# EasyEDA Pro project ProPrj_Starcat_FOC双路矢量控制器_2024-11-11.epro, board 双路大功率矢量控制器_2
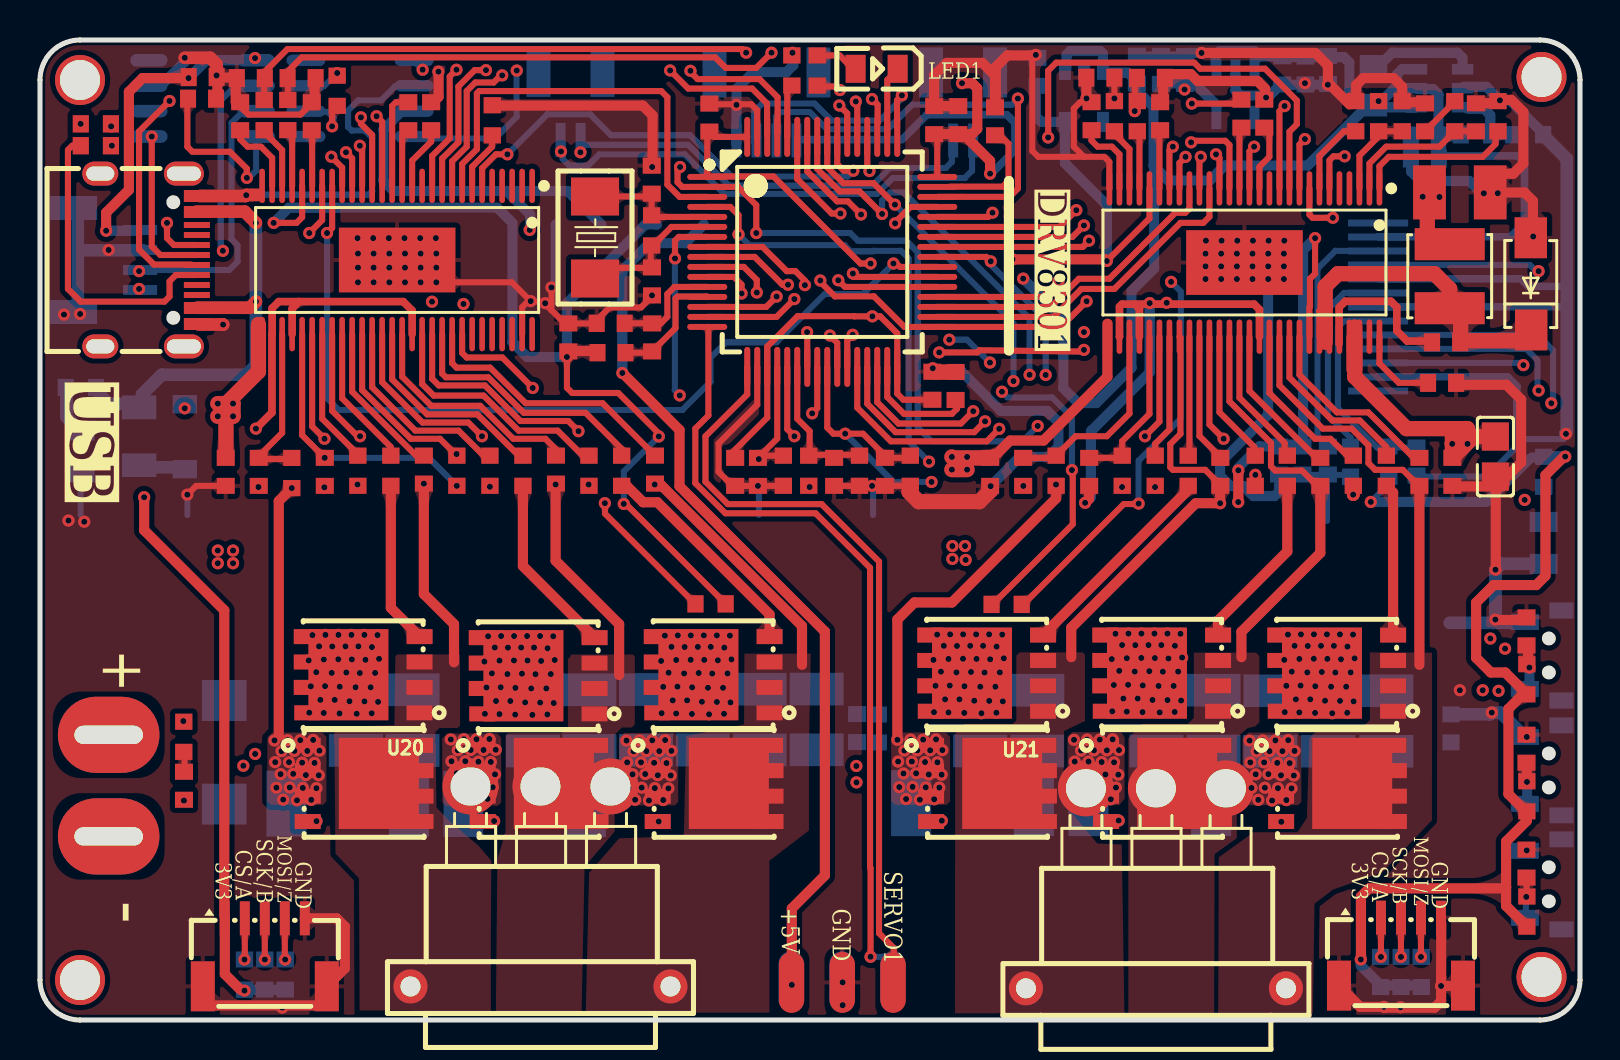
[diagram p7: board, top side]
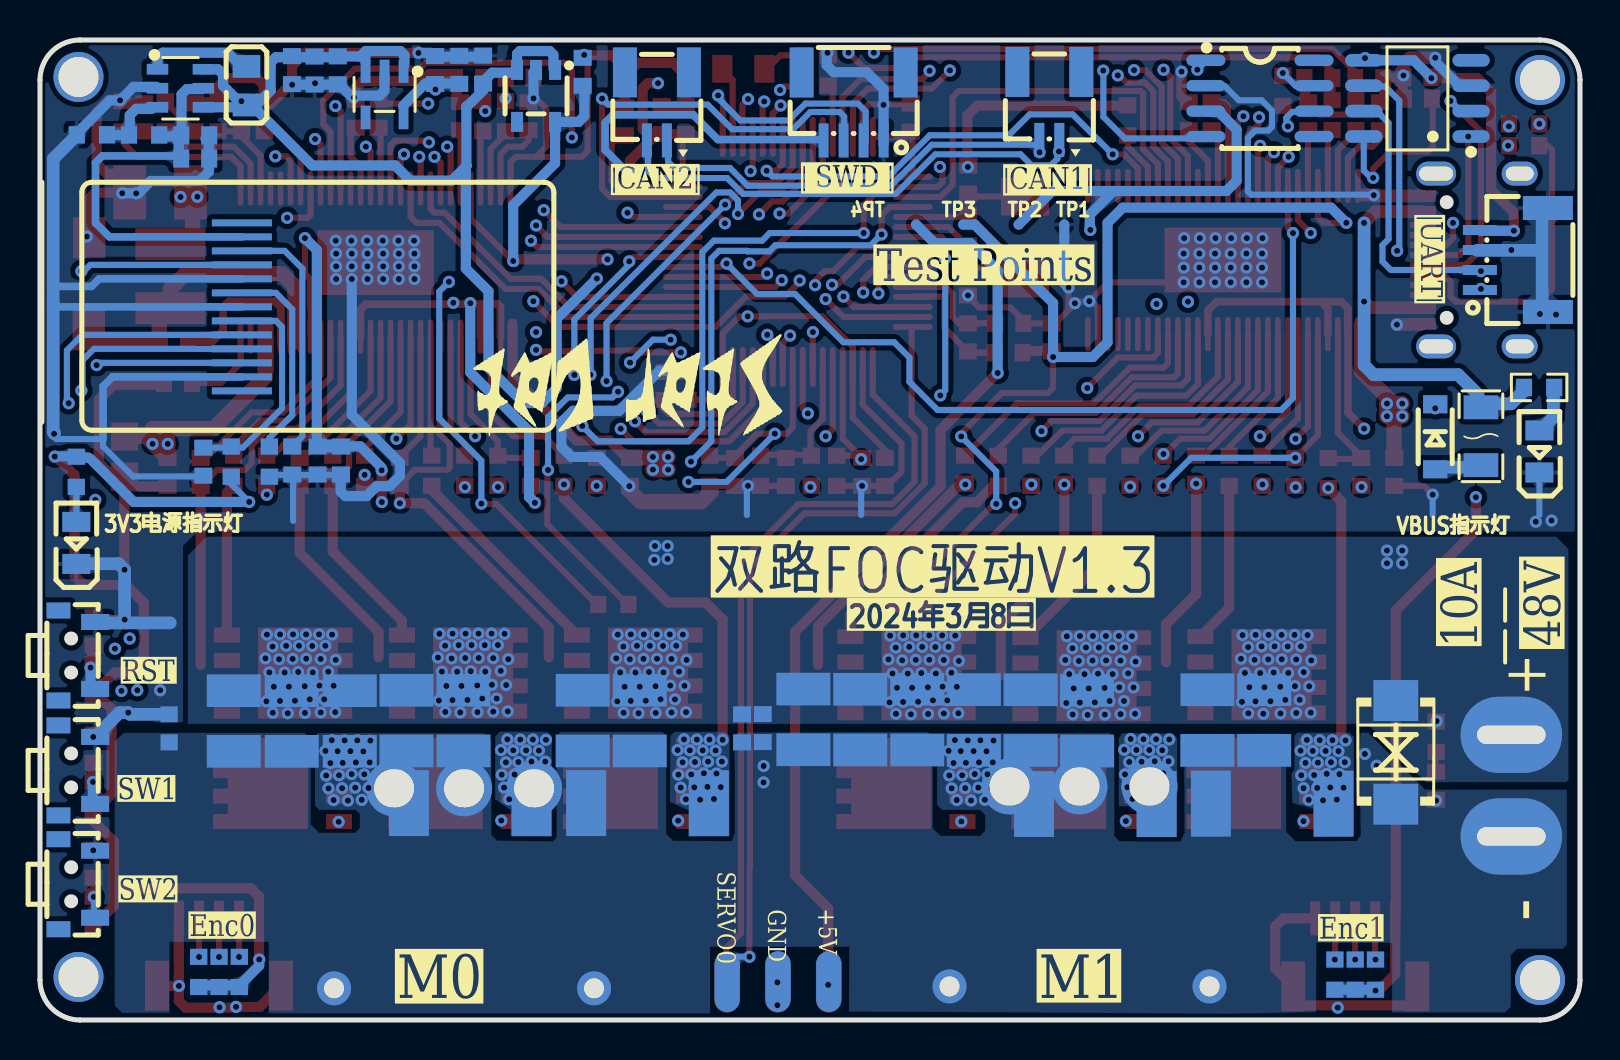
[diagram p8: board, bottom side, seen from below]

Outline 77 x 49 mm; copper layers: Top Layer, Inner1, Inner2, Bottom Layer. Coordinates in mm from the lower left corner of the outline.
Outline path: 0,47 0,2 arc(0.59,0.59) 2,0 75,0 arc(76.41,0.59) 77,2 77,47 arc(76.41,48.41) 75,49 2,49 arc(0.59,48.41) 0,47
Stack: Top Layer 0.035mm 外层铜厚1oz / Dielectric1 0.2104mm 7628 RC49% 8.6mil / Inner1 0.0152mm 内层铜厚 / Dielectric2 1.065mm 1.1mm H/HOZ 含铜 / Inner2 0.0152mm 内层铜厚 / Dielectric3 0.2104mm 7628 RC49% 8.6mil / Bottom Layer 0.035mm 外层铜厚1oz

## Design rules (mm)
template: JLCPCB Capability(Two Layers Board)
spacing copperThickness1oz (default): track to track 0.102, other pairs 0.152 to 0.3
spacing copperThickness2oz: track to track 0.203, other pairs 0.152 to 0.3
track width copperThickness1oz (default): min 0.127, default 0.254, max 2.54
track width copperThickness2oz: min 0.203, default 0.254, max 2.54
differential pair differentialPair (default): width min 0.127, default 0.254, max 2.54; gap min 0.152, default 0.152
via viaSize (default): diameter min 0.5, default 0.61, max 10; hole min 0.3, default 0.305, max 6.3

## Placement (name value [footprint] x y rotation side)
C1  100nF  [C0603]  62.11 47.48 270 bottom
C2  10uF  [C0603]  63.27 47.47 90 bottom
C3  100nF  [C0603]  26.42 34.13 90 top
C4  1uF  [C0603]  54.84 47.52 270 bottom
C5  100nF  [C0603]  30.61 34.13 90 top
C6  10uF  [C0603]  57.25 47.5 270 bottom
C7  100nF  [C0603]  56.04 47.51 90 bottom
C8  1uF  [C0603]  49.87 47.41 270 bottom
C9  10uF  [C0603]  74.32 19.43 270 top
C10  100nF  [C0603]  44.62 31.71 90 top
C11  100nF  [C0603]  45.91 44.99 90 top
C12  100nF  [C0603]  34.76 27.41 270 top
C13  100nF  [C0603]  33.47 45.12 90 top
C14  10uF  [C0603]  44.71 44.99 270 top
C15  2.2uF  [C0603]  45.78 31.7 270 top
C16  22pF  [C0603]  30.59 42.02 90 top
C17  2.2uF  [C0603]  47.75 44.94 270 top
C18  22pF  [C0603]  30.6 36.93 270 top
C19  100nF  [C0603]  8.1 46.07 180 top
C20  10uF  [C0603]  74.32 13.56 270 top
C21  100nF  [C0603]  8.13 47.14 0 top
C23  10uF  [C0603]  74.32 7.82 270 top
C24  1uF  [C0603]  64.4 47.49 90 bottom
C25  10uF  [C0603]  69.24 43.07 0 bottom
C26  10uF  [C0603]  69.24 44.23 0 bottom
C27  100nF  [C0603]  63.12 27.97 270 bottom
C28  10uF  [C0603]  64.39 27.97 270 bottom
C29  10uF  [C0603]  61.95 27.97 90 bottom
C30  10uF  [C0603]  68.83 27.92 90 bottom
C34  100uF  [C1210]  33.14 15.02 90 bottom
C35  100uF  [C1210]  30.31 15 90 bottom
C36  100uF  [C1210]  55.83 14.97 90 bottom
C37  100uF  [C1210]  47.01 14.97 90 bottom
C38  100uF  [C1210]  15.79 15 90 bottom
C39  100uF  [C1210]  24.65 14.97 90 bottom
C41  100nF  [C0603]  40.86 14.59 270 bottom
C43  10nF  [C0603]  7.2 11.71 90 top
C45  10uF  [C0603]  42.25 27.41 90 top
C46  10uF  [C0603]  35.9 27.41 90 top
C50  100uF  [C1210]  35.99 15.02 90 bottom
C51  100uF  [C1210]  38.83 15.03 90 bottom
C52  100uF  [C1210]  58.68 14.97 90 bottom
C53  100uF  [C1210]  49.86 14.97 90 bottom
C54  100uF  [C1210]  27.47 14.99 90 bottom
C55  100uF  [C1210]  18.63 15 90 bottom
C57  100nF  [C0603]  41.9 14.58 270 bottom
C59  82pF  [C0603]  71.79 45.13 270 top
C60  270pF  [C0603]  69.25 45.13 270 top
C61  15nF  [C0603]  70.1 31.86 0 top
C62  100nF  [C0603]  70.62 27.41 270 top
C63  10uF  [C0805]  72.77 28.17 90 top
C64  100nF  [C0603]  70.3 33.88 180 top
C65  100uF  [C1210]  70.99 41.38 180 top
C66  100nF  [C0603]  68.97 27.41 270 top
C67  100nF  [C0603]  30.75 27.52 270 top
C68  10uF  [C0603]  61.21 45.32 270 top
C69  100nF  [C0603]  64.02 27.41 270 top
C70  47nF  [C0603]  60.07 45.32 90 top
C71  10uF  [C0603]  19.56 45.19 270 top
C72  100nF  [C0603]  25.8 27.52 270 top
C73  47nF  [C0603]  18.41 45.19 270 top
C74  100nF  [C0603]  59.01 27.41 270 top
C75  100nF  [C0603]  19.19 27.52 270 top
C76  10uF  [C0603]  56.01 45.19 90 top
C77  10uF  [C0603]  13.59 45.19 90 top
C78  2.2nF  [C0603]  52.46 27.41 90 top
C79  2.2nF  [C0603]  14.24 27.41 90 top
C80  2.2nF  [C0603]  55.54 47.11 180 top
C81  2.2nF  [C0603]  13.08 47.09 180 top
C82  10uF  [C0603]  52.58 45.19 270 top
C83  10uF  [C0603]  10.01 45.19 270 top
C84  2.2nF  [C0603]  53.02 47.11 0 top
C85  100nF  [C0603]  47.51 27.41 270 top
C86  2.2nF  [C0603]  49.16 27.41 90 top
C87  2.2nF  [C0603]  10.54 47.09 0 top
C88  100nF  [C0603]  9.29 27.41 270 top
C89  2.2nF  [C0603]  10.94 27.41 90 top
C94  100uF  [C1210]  67.31 14.95 90 bottom
C95  100uF  [C1210]  64.41 14.95 90 bottom
C97  100uF  [C1210]  61.51 14.95 90 bottom
C98  10uF  [C0603]  39.71 27.41 90 top
CN1  WAFER-SH1.0-4PWB  [CONN-SMD_4P-P1.00_WAFER-SH1.0-4PWB]  36.32 45.68 0 bottom
CN2  WAFER-SH1.0-4PWB  [CONN-SMD_4P-P1.00_WAFER-SH1.0-4PWB]  3.31 38 90 bottom
D1  1N5819W  [SOD-123_L2.7-W1.6-LS3.7-R-RD]  7.24 29.16 270 bottom
D2  SMBJ60CA  [SMB_L4.6-W3.6-LS5.3-BI]  9.21 13.38 90 bottom
D3  SS56  [SMA_L4.3-W2.6-LS5.0-FD]  74.55 36.81 270 top
F1  BSMD1206-050-30V  [F1206]  4.95 29.19 270 bottom
L1  CBG160808U000T  [L0603]  70.54 14.58 270 bottom
L2  22uH  [IND-SMD_L4.0-W4.0]  70.49 37.19 90 top
L3  CBG160808U000T  [L0603]  28.57 33.37 0 top
L4  CBG160808U000T  [L0603]  28.54 34.83 0 top
L5  10uH  [L0805]  66.68 46.71 270 bottom
LED1  NCD0805G1  [LED0805-R-RD]  75.18 23.85 90 bottom
LED2  NCD0805G1  [LED0805-R-RD]  41.83 47.56 180 top
LED3  NCD0805G1  [LED0805-R-RD]  2.03 28.43 90 bottom
NOREF  -  [Pad_e53]  75.08 47.15 0 top
NOREF#2  -  [Pad_e52]  2 47 0 top
NOREF#3  -  [Pad_e49]  2 2 0 top
NOREF#4  -  [Pad_e55]  75.08 2.15 0 top
Q1  BSC0702LS  [PG-TDSON-8_L5.0-W6.0-P1.27-BL-EP]  33.66 17.26 90 top
Q2  BSC0702LS  [PG-TDSON-8_L5.0-W6.0-P1.27-BL-EP]  24.91 17.21 90 top
Q3  BSC0702LS  [PG-TDSON-8_L5.0-W6.0-P1.27-BL-EP]  16.16 17.26 90 top
Q4  BSC0702LS  [PG-TDSON-8_L5.0-W6.0-P1.27-BL-EP]  64.84 17.34 90 top
Q5  BSC0702LS  [PG-TDSON-8_L5.0-W6.0-P1.27-BL-EP]  56.09 17.34 90 top
Q6  BSC0702LS  [PG-TDSON-8_L5.0-W6.0-P1.27-BL-EP]  47.34 17.34 90 top
Q7  BSC0702LS  [PG-TDSON-8_L5.0-W6.0-P1.27-BL-EP]  33.71 11.83 270 top
Q8  BSC0702LS  [PG-TDSON-8_L5.0-W6.0-P1.27-BL-EP]  24.96 11.83 270 top
Q9  BSC0702LS  [PG-TDSON-8_L5.0-W6.0-P1.27-BL-EP]  16.21 11.83 270 top
Q10  BSC0702LS  [PG-TDSON-8_L5.0-W6.0-P1.27-BL-EP]  56.13 11.83 270 top
Q11  BSC0702LS  [PG-TDSON-8_L5.0-W6.0-P1.27-BL-EP]  47.38 11.83 270 top
Q12  BSC0702LS  [PG-TDSON-8_L5.0-W6.0-P1.27-BL-EP]  64.88 11.83 270 top
R1  10kΩ  [R0603]  75.18 27.41 90 bottom
R2  10kΩ  [R0603]  74.34 17.04 90 top
R3  10kΩ  [R0603]  38.86 47.48 270 top
R4  10kΩ  [R0603]  37.59 47.48 90 top
R5  1MΩ  [R0603]  30.58 39.48 90 top
R7  10kΩ  [R0603]  74.34 11.19 90 top
R8  120Ω  [R0603]  14.86 46.46 90 top
R9  10kΩ  [R0603]  74.34 5.42 90 top
R10  750kΩ  [R0603]  71.8 44.25 180 bottom
R11  3.3kΩ  [R0603]  10.22 2.27 270 bottom
R12  3.3kΩ  [R0603]  11.24 2.27 270 bottom
R13  3.3kΩ  [R0603]  12.26 2.27 270 bottom
R14  75kΩ  [R0603]  74.41 44.26 180 bottom
R15  3.3kΩ  [R0603]  67.03 2.4 270 bottom
R16  3.3kΩ  [R0603]  68.05 2.4 270 bottom
R17  3.3kΩ  [R0603]  69.06 2.4 270 bottom
R18  560kΩ  [R0603]  65.53 27.92 90 bottom
R20  3.3Ω  [R0603]  7.19 14.16 90 top
R21  39kΩ  [R0603]  38.44 27.46 270 top
R22  NCP18XH103F03RB  [R0603]  33.53 20.81 0 top
R23  NCP18XH103F03RB  [R0603]  48.33 20.78 0 top
R24  2.2kΩ  [R0603]  40.98 27.46 90 top
R25  3.3kΩ  [R0603]  43.52 27.46 90 top
R26  3.3kΩ  [R0603]  37.17 27.46 90 top
R27  47kΩ  [R0603]  70.74 45.19 270 top
R28  220kΩ  [R0603]  72.9 45.19 90 top
R29  18kΩ  [R0603]  66.93 45.19 270 top
R30  3.3kΩ  [R0603]  68.11 45.19 270 top
R31  18kΩ  [R0603]  22.62 44.98 90 top
R32  18kΩ  [R0603]  65.79 45.19 90 top
R33  22Ω  [R0603]  54.86 45.19 270 top
R34  120Ω  [R0603]  54.11 27.46 270 top
R35  22Ω  [R0603]  12.39 45.25 270 top
R36  120Ω  [R0603]  20.84 27.46 90 top
R37  22Ω  [R0603]  53.72 45.19 270 top
R38  120Ω  [R0603]  50.81 27.46 270 top
R39  22Ω  [R0603]  11.21 45.25 270 top
R40  120Ω  [R0603]  12.59 27.35 270 top
R41  2.2Ω  [R0603]  29.08 27.46 270 top
R42  2.2Ω  [R0603]  24.15 27.46 270 top
R43  2.2Ω  [R0603]  17.54 27.46 270 top
R44  2.2Ω  [R0603]  67.32 27.46 270 top
R45  2.2Ω  [R0603]  62.37 27.46 270 top
R46  2.2Ω  [R0603]  57.41 27.46 270 top
R47  2.2Ω  [R0603]  27.45 27.46 270 top
R48  2.2Ω  [R0603]  22.5 27.46 270 top
R49  2.2Ω  [R0603]  15.89 27.46 270 top
R50  2.2Ω  [R0603]  60.76 27.46 270 top
R51  2.2Ω  [R0603]  55.76 27.46 270 top
R52  2.2Ω  [R0603]  65.67 27.46 270 top
R53  10mΩ  [RES-SMD_L6.4-W3.2-R2512]  24.23 10.8 180 bottom
R54  10mΩ  [RES-SMD_L6.4-W3.2-R2512]  15.39 10.82 180 bottom
R55  10mΩ  [RES-SMD_L6.4-W3.2-R2512]  55.49 10.84 180 bottom
R56  10mΩ  [RES-SMD_L6.4-W3.2-R2512]  46.62 10.84 180 bottom
R57  10kΩ  [R0603#2]  2.03 31.6 0 bottom
R58  10kΩ  [R0603]  67.44 27.92 270 bottom
R59  22Ω  [R0603]  2.79 44.81 0 top
R60  22Ω  [R0603]  2.79 43.72 0 top
SW1  TS24CA 250gf 013  [SW-SMD_L4.7-W3.5-P3.35-EH]  75.16 18.23 90 bottom
SW2  TS24CA 250gf 013  [SW-SMD_L4.7-W3.5-P3.35-EH]  75.16 12.48 90 bottom
SW3  TS24CA 250gf 013  [SW-SMD_L4.7-W3.5-P3.35-EH]  75.16 6.79 90 bottom
TP1  -  [Test-Point-0.5mm]  25.79 39.77 180 bottom
TP2  -  [Test-Point-0.5mm]  28.07 39.77 180 bottom
TP3  -  [Test-Point-0.5mm]  30.84 39.77 180 bottom
TP4  -  [test-point-0.5mm]  33.19 39.77 0 top
U1  SPX3819M5-L-3-3/TR  [SOT-23-5_L3.0-W1.7-P0.95-LS2.8-BL]  59.77 46.28 0 bottom
U2  LP5907MFX-3.3/NOPB  [SOT-23-5_L3.0-W1.7-P0.95-LS2.8-BR]  52.2 46.21 90 bottom
U3  -  [舵机接口]  40.1 1.79 0 bottom
U4  -  [舵机接口]  40.12 2.01 0 top
U5  CH340N  [SOP-8_L4.9-W3.9-P1.27-LS6.0-BL]  8.13 46.08 90 bottom
U7  TLV61046ADBVR  [SOT-23-6_L2.9-W1.6-P0.95-LS2.8-BL]  69.98 46.59 270 bottom
U8  WAFER-SH1.0-2PWB  [CONN-SMD_2P-P1.00_XUNPU_WAFER-SH1.0-2PWB]  26.53 45.7 0 bottom
U9  WAFER-SH1.0-2PWB  [CONN-SMD_2P-P1.00_XUNPU_WAFER-SH1.0-2PWB]  46.16 45.68 0 bottom
U10  ZX-SH1.0-5PWT  [CONN-SMD_5P-P1.00_MEGASTAR_ZX-SH1.0-5PWT]  11.24 3.38 0 top
U11  -  [电源接口]  3.43 11.72 270 top
U12  OLED-128x80-0.78寸  [oled-128x80-0.78寸]  51.31 41.89 270 bottom
U13  ZX-SH1.0-5PWT  [CONN-SMD_5P-P1.00_MEGASTAR_ZX-SH1.0-5PWT]  68.05 3.42 0 top
U16  STM32F405RGT6  [LQFP-64_L10.0-W10.0-P0.50-LS12.0-BL]  39.11 38.4 270 top
U17  DRV8301DCAR  [HTSSOP-56_L14.0-W6.0-P0.50-LS8.0-BL]  60.22 37.87 180 top
U18  DRV8301DCAR  [HTSSOP-56_L14.0-W6.0-P0.50-LS8.0-BL]  17.86 38 180 top
U19  SN65HVD232DR  [SOIC-8_L5.0-W4.0-P1.27-LS6.0-BL]  16 46.08 270 bottom
U20  MR30PW-M30.G.Y  [CONN-TH_MR30PW-M30-G-Y]  25.02 6.68 0 top
U21  MR30PW-M30.G.Y  [CONN-TH_MR30PW-M30-G-Y]  55.8 6.58 0 top
USB1  KH-TYPE-C-16P  [USB-C-SMD_KH-TYPE-C-16P]  5.43 38 270 top
X1  8MHz  [CRYSTAL-SMD_L5.0-W3.2]  27.75 39.12 90 top

## Footprints (pads in the part's own frame, mm; a bottom-side part is the same pattern mirrored in y, then rotated)
C0603
  rect 0.8x0.9 smd: 1(-0.7,0) 2(0.7,0)
C0805
  rect 1.41x1.35 smd: 1(-1,0) 2(1,0)
C1210
  rect 1.635x2.7 smd: 1(-1.518,0) 2(1.518,0)
CONN-SMD_2P-P1.00_XUNPU_WAFER-SH1.0-2PWB
  rect 0.5x1.7 smd: 1(-0.5,1.7) 2(0.5,1.7)
  rect 1.2x2.5 smd: 3(1.6,-1.7) 4(-1.6,-1.7)
CONN-SMD_4P-P1.00_WAFER-SH1.0-4PWB
  rect 0.5x1.7 smd: 1(-1.5,1.7) 2(-0.5,1.7) 3(0.5,1.7) 4(1.5,1.7)
  rect 1.2x2.5 smd: 5(-2.6,-1.7) 6(2.6,-1.7)
CONN-SMD_5P-P1.00_MEGASTAR_ZX-SH1.0-5PWT
  rect 0.5x1.7 smd: 1(-2,1.7) 2(-1,1.7) 3(0,1.7) 4(1,1.7) 5(2,1.7)
  rect 1.2x2.5 smd: 6(3.1,-1.7) 7(-3.1,-1.7)
CONN-TH_MR30PW-M30-G-Y
  round 2.8 hole 1.995x1.9: 1(-3.5,5) 2(0,5) 3(3.5,5)
  round 1.7 hole 1: 4(6.5,-5) 5(-6.5,-5)
CRYSTAL-SMD_L5.0-W3.2
  rect 1.9x2.4 smd: 1(-2.05,0) 2(2.05,0)
F1206
  rect 1.19x1.728 smd: 1(-1.445,0) 2(1.445,0)
HTSSOP-56_L14.0-W6.0-P0.50-LS8.0-BL
  oval 0.28x1.715 smd: 1(-6.75,-3.708) 2(-6.25,-3.708) 3(-5.75,-3.708) 4(-5.25,-3.708) 5(-4.75,-3.708) 6(-4.25,-3.708) 7(-3.75,-3.708) 8(-3.25,-3.708) 9(-2.75,-3.708) 10(-2.25,-3.708) 11(-1.75,-3.708) 12(-1.25,-3.708) 13(-0.75,-3.708) 14(-0.25,-3.708) 15(0.25,-3.708) 16(0.75,-3.708) 17(1.25,-3.708) 18(1.75,-3.708) 19(2.25,-3.708) 20(2.75,-3.708) 21(3.25,-3.708) 22(3.75,-3.708) 23(4.25,-3.708) 24(4.75,-3.708) 25(5.25,-3.708) 26(5.75,-3.708) 27(6.25,-3.708) 28(6.75,-3.708) 29(6.75,3.708) 30(6.25,3.708) 31(5.75,3.708) 32(5.25,3.708) 33(4.75,3.708) 34(4.25,3.708) 35(3.75,3.708) 36(3.25,3.708) 37(2.75,3.708) 38(2.25,3.708) 39(1.75,3.708) 40(1.25,3.708) 41(0.75,3.708) 42(0.25,3.708) 43(-0.25,3.708) 44(-0.75,3.708) 45(-1.25,3.708) 46(-1.75,3.708) 47(-2.25,3.708) 48(-2.75,3.708) 49(-3.25,3.708) 50(-3.75,3.708) 51(-4.25,3.708) 52(-4.75,3.708) 53(-5.25,3.708) 54(-5.75,3.708) 55(-6.25,3.708) 56(-6.75,3.708)
  rect 5.825x3.235 smd: 57(0,0)
IND-SMD_L4.0-W4.0
  rect 1.6x3.5 smd: 1(-1.6,0) 2(1.6,0)
L0603
  rect 0.8x0.864 smd: 1(-0.7,0) 2(0.7,0)
L0805
  rect 1.133x1.377 smd: 1(-0.966,0) 2(0.966,0)
LED0805-R-RD
  rect 1x1.399 smd: 1(1.05,0) 2(-1.05,0)
LQFP-64_L10.0-W10.0-P0.50-LS12.0-BL
  oval 0.3x2 smd: 1(-3.75,-5.75) 2(-3.25,-5.75) 3(-2.75,-5.75) 4(-2.25,-5.75) 5(-1.75,-5.75) 6(-1.25,-5.75) 7(-0.75,-5.75) 8(-0.25,-5.75) 9(0.25,-5.75) 10(0.75,-5.75) 11(1.25,-5.75) 12(1.75,-5.75) 13(2.25,-5.75) 14(2.75,-5.75) 15(3.25,-5.75) 16(3.75,-5.75) 33(3.75,5.75) 34(3.25,5.75) 35(2.75,5.75) 36(2.25,5.75) 37(1.75,5.75) 38(1.25,5.75) 39(0.75,5.75) 40(0.25,5.75) 41(-0.25,5.75) 42(-0.75,5.75) 43(-1.25,5.75) 44(-1.75,5.75) 45(-2.25,5.75) 46(-2.75,5.75) 47(-3.25,5.75) 48(-3.75,5.75)
  oval 2x0.3 smd: 17(5.75,-3.75) 18(5.75,-3.25) 19(5.75,-2.75) 20(5.75,-2.25) 21(5.75,-1.75) 22(5.75,-1.25) 23(5.75,-0.75) 24(5.75,-0.25) 25(5.75,0.25) 26(5.75,0.75) 27(5.75,1.25) 28(5.75,1.75) 29(5.75,2.25) 30(5.75,2.75) 31(5.75,3.25) 32(5.75,3.75) 49(-5.75,3.75) 50(-5.75,3.25) 51(-5.75,2.75) 52(-5.75,2.25) 53(-5.75,1.75) 54(-5.75,1.25) 55(-5.75,0.75) 56(-5.75,0.25) 57(-5.75,-0.25) 58(-5.75,-0.75) 59(-5.75,-1.25) 60(-5.75,-1.75) 61(-5.75,-2.25) 62(-5.75,-2.75) 63(-5.75,-3.25) 64(-5.75,-3.75)
oled-128x80-0.78寸
  rect 0.35x3 smd: 1(2.032,-15.6) 2(2.732,-15.6) 3(3.432,-15.6) 4(4.132,-15.6) 5(4.832,-15.6) 6(5.532,-15.6) 7(6.232,-15.6) 8(6.932,-15.6) 9(7.632,-15.6) 10(8.332,-15.6) 11(9.032,-15.6) 12(9.732,-15.6) 13(10.432,-15.6)
Pad_e49
  round 2.5 hole 2: 14(0,0)
Pad_e52
  round 2.5 hole 2: 14(0,0)
Pad_e53
  round 2.5 hole 2: 14(0,0)
Pad_e55
  round 2.5 hole 2: 14(0,0)
PG-TDSON-8_L5.0-W6.0-P1.27-BL-EP
  rect 0.75x1.3 smd: 1(-1.905,-2.82) 2(-0.635,-2.82) 3(0.635,-2.82) 4(1.905,-2.82) 5(1.905,2.82) 6(0.635,2.82) 7(-0.635,2.82) 8(-1.905,2.794)
  rect 4.56x4 smd: 8(0,0.737)
R0603
  rect 0.806x0.864 smd: 1(-0.753,0) 2(0.753,0)
R0603#2
  rect 0.806x0.864 smd: 1(-0.741,-0.027) 2(0.766,-0.027)
RES-SMD_L6.4-W3.2-R2512
  rect 2x3.3 smd: 1(-3.067,0) 2(3.067,0)
SMA_L4.3-W2.6-LS5.0-FD
  rect 2.046x1.62 smd: 1(-2.304,-0.009) 2(2.304,0.009)
SMB_L4.6-W3.6-LS5.3-BI
  rect 2.047x2.241 smd: 1(-2.591,0) 2(2.591,0)
SOD-123_L2.7-W1.6-LS3.7-R-RD
  rect 0.909x1.219 smd: 1(1.625,0) 2(-1.625,0)
SOIC-8_L5.0-W4.0-P1.27-LS6.0-BL
  oval 0.569x1.95 smd: 1(-1.905,-2.705) 2(-0.635,-2.705) 3(0.635,-2.705) 4(1.905,-2.705) 5(1.905,2.705) 6(0.635,2.705) 7(-0.635,2.705) 8(-1.905,2.705)
SOP-8_L4.9-W3.9-P1.27-LS6.0-BL
  oval 0.63x1.865 smd: 1(-1.905,-2.683) 2(-0.635,-2.683) 3(0.635,-2.683) 4(1.905,-2.683) 5(1.905,2.683) 6(0.635,2.683) 7(-0.635,2.683) 8(-1.905,2.683)
SOT-23-5_L3.0-W1.7-P0.95-LS2.8-BL
  rect 0.49x1.157 smd: 1(-0.95,-1.153) 2(0,-1.153) 3(0.95,-1.153)
  rect 0.49x1.175 smd: 4(0.95,1.153) 5(-0.95,1.153)
SOT-23-5_L3.0-W1.7-P0.95-LS2.8-BR
  rect 1x0.6 smd: 1(1.3,-0.95) 2(1.3,0) 3(1.3,0.95) 4(-1.3,0.95) 5(-1.3,-0.95)
SOT-23-6_L2.9-W1.6-P0.95-LS2.8-BL
  rect 0.532x1.072 smd: 1(-0.95,-1.149) 2(0,-1.149) 3(0.95,-1.149) 4(0.95,1.149) 5(0,1.149) 6(-0.95,1.149)
SW-SMD_L4.7-W3.5-P3.35-EH
  rect 0.8x1.4 smd: 1(-1.675,-0.917) 2(1.675,-0.917)
  rect 0.8x1.2 smd: 3(-2.25,0.917) 4(2.25,0.917)
test-point-0.5mm
  round 0.5 smd far side: 1(0,0)
Test-Point-0.5mm
  round 0.5 smd: 1(0,0)
USB-C-SMD_KH-TYPE-C-16P
  oval 1.2x2 hole 0.7x1.7: 1(-4.32,1.765) 2(4.32,1.765)
  oval 1.2x1.8 hole 0.7x1.4: 3(-4.32,-2.415) 4(4.32,-2.415)
  rect 0.3x1.3 smd: A1(-3.35,2.415) A4(-2.55,2.415) A5(-1.25,2.415) A6(-0.25,2.415) A7(0.25,2.415) A8(1.25,2.415) A9(2.55,2.415) A12(3.35,2.415) B1(3.05,2.415) B4(2.25,2.415) B5(1.75,2.415) B6(0.75,2.415) B7(-0.75,2.415) B8(-1.75,2.415) B9(-2.25,2.415) B12(-3.05,2.415)
电源接口
  rrect 3.81x5.08 hole 0.914x3.429: 1(-2.54,0) 2(2.54,0)
舵机接口
  rrect 1.27x3.048 smd: 1(-2.54,-0.127) 2(0,-0.127) 3(2.54,-0.127)

## Nets
As in the schematic, except:
+3V3: C6.2 C7.1 C10.1 C11.1 C12.1 C13.1 C14.2 C21.1 C24.2 C27.1 C29.2 CN1.4 CN2.4 L5.2 R1.2 R2.1 R3.2 R7.1 R9.1 R11.2 R12.2 R13.2 R15.2 R16.2 R17.2 R58.2 TP2.1 TP4.1 U1.5 U5.5 U7.4 U7.6 U10.1 U12.4 U13.1 U16.1 U16.19 U16.32 U16.48 U16.64 U17.49 U18.49 U19.3
+5V: C1.1 C2.2 C4.2 C65.2 D1.2 L2.2 R29.1 U1.1 U1.3 U2.1 U2.3 U3.1 U4.1

Pads without a net: CN1 5 6; NOREF 14; NOREF#2 14; NOREF#3 14; NOREF#4 14; SW1 3 4; SW2 3 4; SW3 3 4; U1 4; U2 4; U5 4; U8 3 4; U9 3 4; U12 1 13; U17 4 5 12 55; U18 1 2 3 4 5 12 50 51 52 53 54 56; U19 5 8; U20 4 5; U21 4 5; USB1 1 2 3 4 A5 A8 B5 B8

## Via types
v1: diameter 0.61, hole 0.305, Top Layer to Bottom Layer, 673 vias

## Routing (per net, layer and track width the routed paths; a pad name or vN(x,y) marks a point on that pad's centre or on a via; arc(x,y) is an arc through that point)
+3V3: length 524.4
  Top Layer w0.305: v1(40,46.5) 39.82,46.68 38.88,46.68 ; v1(24.64,31.6) 23.11,33.12 21.34,33.12 21.11,33.35 U18.49 ; 34.63,28.11 34.63,28.38 36.36,30.12 U16.19 36.36,33.67 37.88,35.19 40.71,35.19 40.72,35.18 v1(41.62,35.18) 42.01,35.18 42.86,34.33 U16.32 42.86,31.32 43.17,31.01 C10.1 ; v1(63.75,39.09) 63.75,37.32 63.5,37.06 63.5,35.67 63.47,35.64 U17.49 ; C14.2 44.86,44.14 U16.48 ; 33.46,42.18 36.67,42.18 41.03,37.82 v1(41.53,37.82) ; 33.36,42.15 33.36,44.32 33.47,44.42 33.74,44.15 U16.64
  Top Layer w0.508: v1(66.04,3.03) 66.05,3.03 U13.1 66.05,6.17 66.46,6.58 73.25,6.58 73.3,6.64 ; 46.16,44.29 46.6,44.29 46.86,44.56 46.86,46.59 46.61,46.84 v1(46.1,46.84) ; 46.16,44.29 C11.1 C14.2 ; 46.16,44.29 47.5,42.95 v1(47.5,42.32) ; v1(5.21,26.14) 5.21,24.49 9.21,20.48 9.21,5.22 ; 73.3,6.64 73.3,5.71 R9.1 ; 73.3,6.64 73.3,8.92 74.34,9.96 74.34,10.38 73.42,11.3 73.42,15.56 74.18,16.32 ; v1(3.31,39.46) 3.31,40.37 4.44,41.51 4.44,46.41 5.13,47.09 v1(7.43,47.09) ; U10.1 9.24,2.29 10.03,1.5 ; 74.27,16.37 73.26,17.38 72.54,17.38 71.81,18.11 71.81,20.87 72.68,21.75 74.81,21.75 75.27,22.21 75.27,27.25 76.18,28.16 ; 29.15,32.3 29.18,32.3 31.98,29.5 31.98,26.69 39.24,19.42 39.24,7.23 37.59,5.58 37.59,2.39 ; v1(59.91,25.9) 59.92,25.91 v1(59.92,27.49)
  Top Layer w0.762: 69.37,38.71 69.37,41.1 69.42,41.15
  Inner1 w0.305: 40.01,46.59 40.26,46.84 v1(46.1,46.84)
  Inner1 w0.508: 59.68,41.64 59.68,44.13 58.97,44.84 56.99,44.84 56.68,45.15 56.68,45.98 v1(57.23,46.52) 56.91,46.84 v1(46.1,46.84) ; 59.68,41.64 59.63,41.64 53.19,35.19 50.42,35.19 ; 59.68,41.64 62.99,41.64 63.75,40.87 v1(63.75,39.09) 63.75,38.46 64.9,37.32 74.8,37.32 v1(74.93,37.44) ; 50.42,35.19 50.41,35.2 ; 50.42,35.19 41.63,35.19 41.62,35.19 ; v1(41.53,37.82) 41.59,37.76 41.59,35.19 ; 41.62,35.19 41.59,35.15 41.59,35.19 ; 41.62,35.19 41.59,35.19 ; 41.59,35.19 38,35.19 36.07,33.25 32.77,33.25 31.14,31.63 25.46,31.63 ; v1(24.48,39.5) 24.44,39.55 23.08,39.55 22.19,38.65 ; 22.19,38.65 22.19,35.27 25.46,32 25.46,31.63 ; 22.19,38.65 20.57,40.27 15.7,40.27 14.16,41.81 12.27,41.81 10.73,43.35 10.73,48.09 10.77,48.13 ; v1(59.92,27.49) 59.92,25.57 60.38,25.1 65.74,25.1 v1(66.54,25.9) ; 25.46,31.63 6.32,31.63 5.21,30.51 v1(5.21,26.14)
  Inner1 w0.635: v1(69.97,41.15) 68.17,41.15 66.93,42.4 66.93,43.2 ; 64.52,45.18 64.95,45.18 66.93,43.2 ; 66.93,43.2 v1(66.93,45.94)
  Inner2 w0.508: v1(49.16,37.07) 46.99,34.9 44.2,34.9 41.61,32.31 9.09,32.31 7.37,30.58 v1(7.24,30.58)
  Bottom Layer w0.305: U12.4 74.49,37.76 74.93,37.31 74.93,37.44 v1(74.93,37.44) ; v1(66.54,25.9) 67.54,26.91 67.54,27.03
  Bottom Layer w0.381: 37.86,44.02 43.1,44.02 44.34,45.26 48.35,45.26 48.74,44.86 48.74,43.5 47.5,42.25 47.5,42.29
  Bottom Layer w0.508: 51.33,47.59 51.33,48.26 51.52,48.45 53,48.45 53.15,48.3 53.15,47.51 ; 23.33,41.45 26.39,41.45 TP2.1 ; 23.33,41.45 17.68,41.45 17.17,41.96 17.17,44.52 18.07,45.42 18.67,45.42 ; 23.33,41.45 24.51,40.27 24.51,39.55 24.5,39.55 ; 61.7,28.68 60.98,28.68 59.92,27.62 ; 66.68,45.49 66.15,45.49 63.39,42.73 59.24,42.73 58.48,41.97 56.41,41.97 55.71,42.67 ; 60.99,48.18 62.01,48.18 62.05,48.14 65.2,48.14 65.47,47.88 65.47,46.47 66.1,45.84 ; 60.99,48.18 60.74,48.18 60.74,47.93 ; 60.99,48.18 60.72,48.45 58.98,48.45 58.78,48.24 58.78,47.76 ; 58.84,45.72 57.74,46.82 56.05,46.82 ; 55.71,42.67 55.68,42.7 55.68,42.7 ; 55.71,42.67 55.71,37.57 54.58,36.44 54.58,32.61 52.81,30.85 51.91,30.85 51.17,31.59 51.17,35.04 51.15,35.06 ; v1(59.91,25.9) 59.92,25.91 ; 67.03,1.73 66.04,2.72 v1(66.04,3.03) ; 67.03,1.73 R15.2 ; 67.03,1.73 67,1.73 ; 67.03,1.73 68.97,1.73 69.01,1.76 ; U7.6 68.1,47.54 67.85,47.29 67.85,46.72 67.11,45.97 ; 75.28,28.09 75.25,28.12 74.59,28.12 ; 55.68,42.7 55.68,45.64 ; 55.68,42.7 55.67,42.72 ; 55.68,45.64 54.84,46.48 54.84,46.82 ; 55.68,45.64 55.68,45.68 ; 53.4,47.37 53.41,47.36 54.39,47.36 54.88,46.87 ; 66.93,45.75 67.04,45.64 U7.4 ; v1(3.31,39.46) 4.97,39.46 CN2.4 ; v1(63.75,39.09) 63.16,38.5 63.16,28.68 ; v1(76.26,28.17) 76.25,28.19 75.21,28.19 ; v1(7.43,47.09) 8.32,47.99 10.81,47.99 ; v1(49.16,37.07) 51.12,35.11 ; v1(66.54,25.9) 72.32,25.9 74.46,28.05 ; R13.2 R12.2 R11.2 ; v1(29.12,32.35) 29.12,37.48 30.48,38.84 32.26,38.84 TP4.1